# EasyEDA Pro project Athena.eprj, schematic Schematic, sheets 3 to 4 of 4

## Sheets
3 Peripherals: Page Name: Peripherals
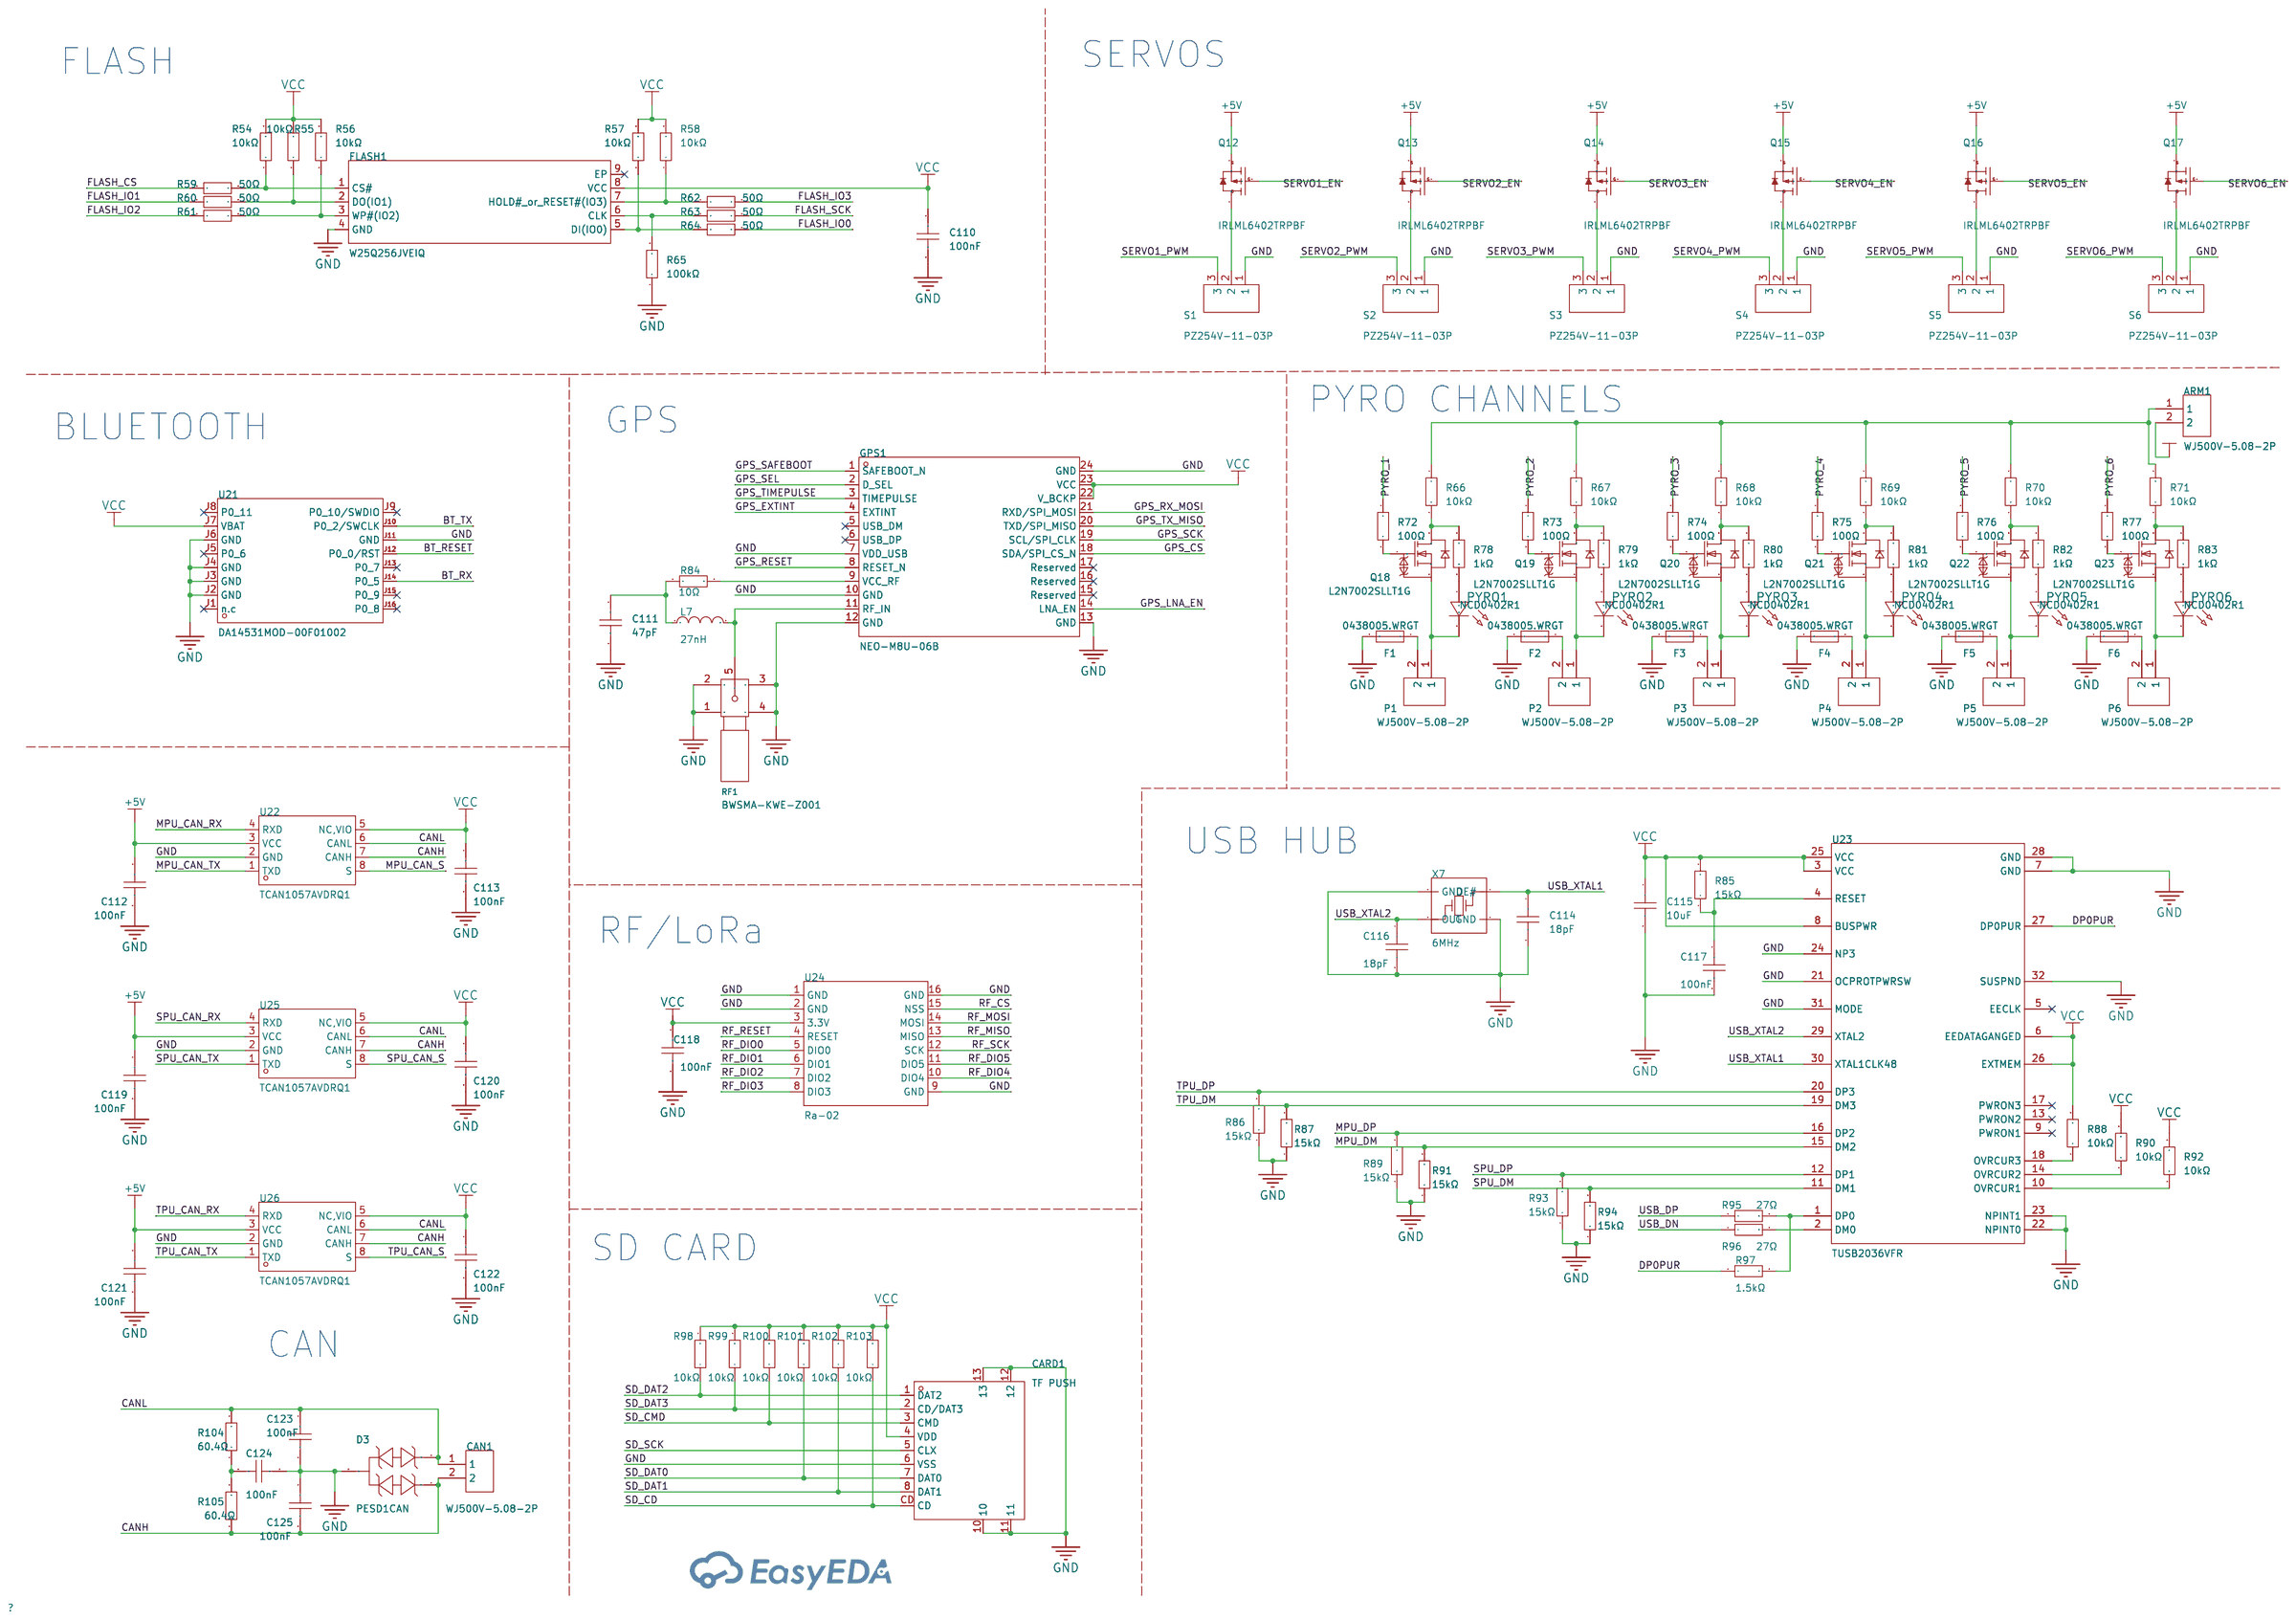
[diagram p2: Peripherals]
4 Sensors: Page Name: Sensors; Update Date: 2025-08-21
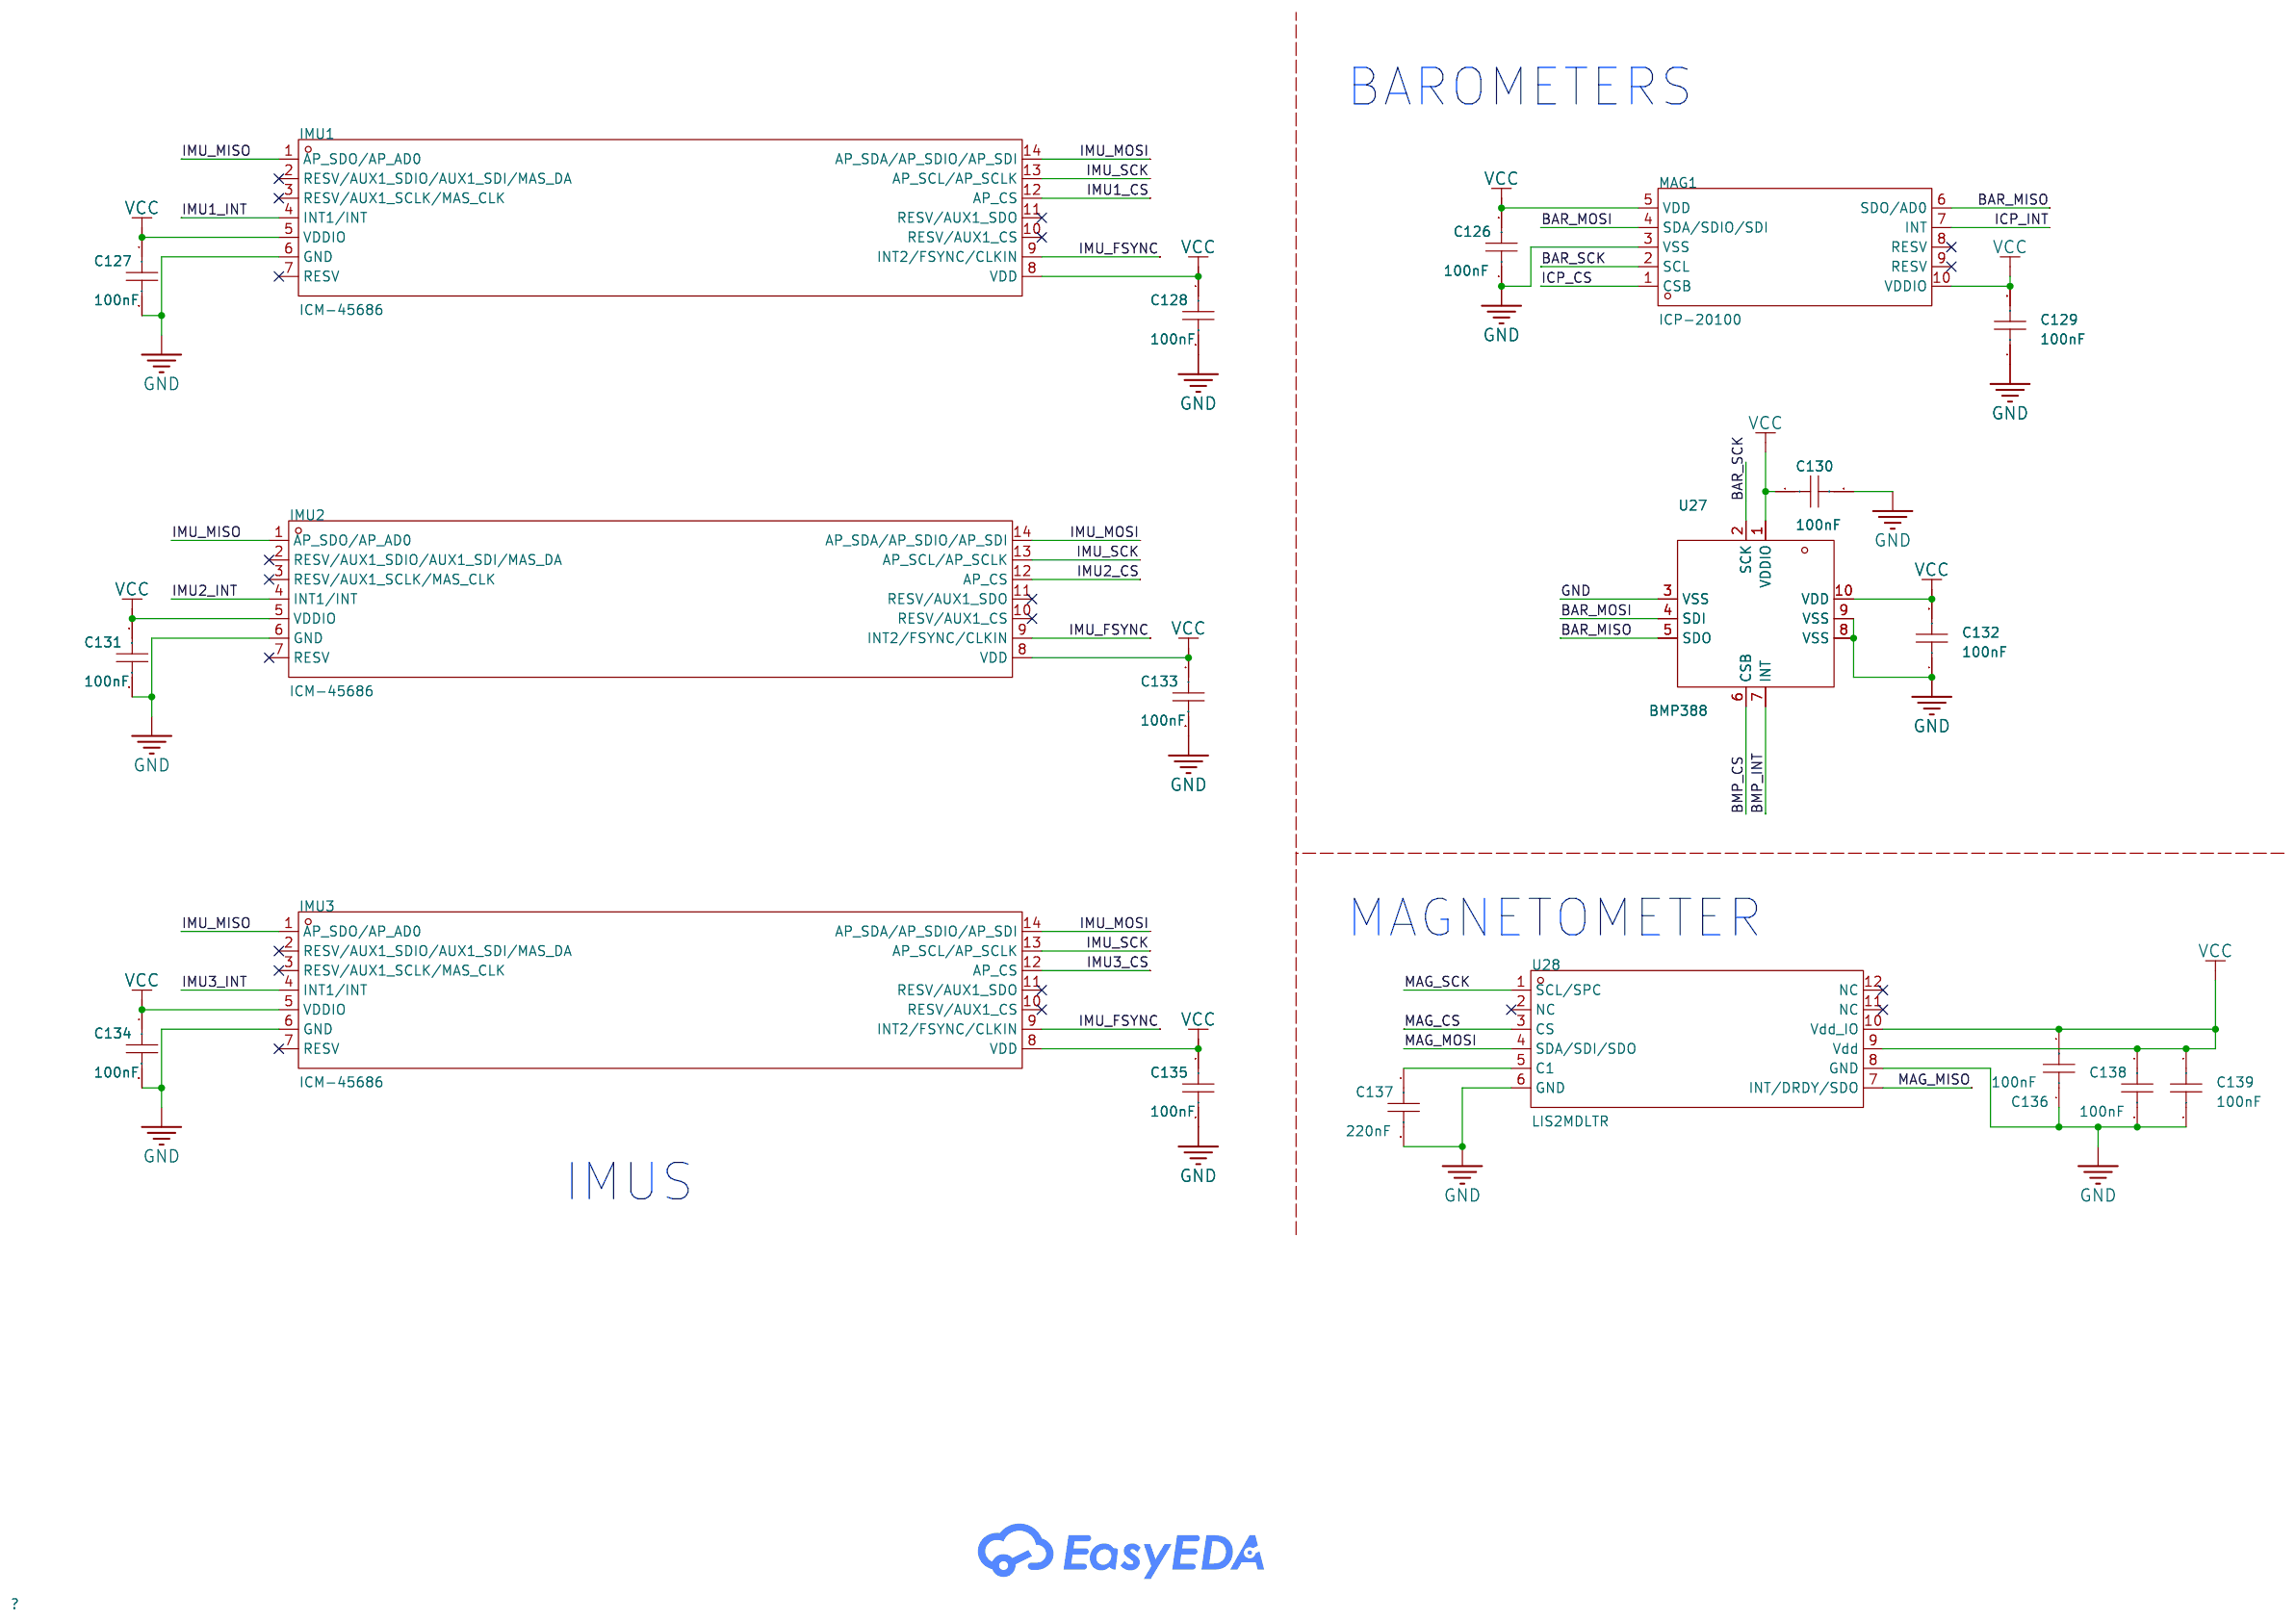
[diagram p3: Sensors]

## Parts
sheet Peripherals
ARM1  WJ500V-5.08-2P  [CONN-TH_2P-P5.00_WJ500V-5.08-2P]
C110  100nF  [C0402]
C111  47pF  [C0402]
C112  100nF  [C0402]
C113  100nF  [C0402]
C114  18pF  [C0402]
C115  10uF  [C0805]
C116  18pF  [C0402]
C117  100nF  [C0402]
C118  100nF  [C0402]
C119  100nF  [C0402]
C120  100nF  [C0402]
C121  100nF  [C0402]
C122  100nF  [C0402]
C123  100nF  [C0402]
C124  100nF  [C0402]
C125  100nF  [C0402]
CAN1  WJ500V-5.08-2P  [CONN-TH_2P-P5.00_WJ500V-5.08-2P]
CARD1  TF PUSH  [TF-SMD_TF-PUSH]
D3  PESD1CAN  [SOT-23-3_L2.9-W1.6-P1.90-LS2.8-BR]
F1  0438005.WRGT  [F0603]
F2  0438005.WRGT  [F0603]
F3  0438005.WRGT  [F0603]
F4  0438005.WRGT  [F0603]
F5  0438005.WRGT  [F0603]
F6  0438005.WRGT  [F0603]
FLASH1  W25Q256JVEIQ  [WSON-8_L8.0-W6.10-P1.27-BL-EP]
GPS1  NEO-M8U-06B  [GPSM-SMD_24P-L16.0-W12.2-P1.10-TL]
L7  27nH  [L0402-RD]
P1  WJ500V-5.08-2P  [CONN-TH_2P-P5.00_WJ500V-5.08-2P]
P2  WJ500V-5.08-2P  [CONN-TH_2P-P5.00_WJ500V-5.08-2P]
P3  WJ500V-5.08-2P  [CONN-TH_2P-P5.00_WJ500V-5.08-2P]
P4  WJ500V-5.08-2P  [CONN-TH_2P-P5.00_WJ500V-5.08-2P]
P5  WJ500V-5.08-2P  [CONN-TH_2P-P5.00_WJ500V-5.08-2P]
P6  WJ500V-5.08-2P  [CONN-TH_2P-P5.00_WJ500V-5.08-2P]
PYRO1  NCD0402R1  [LED0402-RD]
PYRO2  NCD0402R1  [LED0402-RD]
PYRO3  NCD0402R1  [LED0402-RD]
PYRO4  NCD0402R1  [LED0402-RD]
PYRO5  NCD0402R1  [LED0402-RD]
PYRO6  NCD0402R1  [LED0402-RD]
Q12  IRLML6402TRPBF  [SOT-23-3_L2.9-W1.3-P1.90-LS2.4-BR]
Q13  IRLML6402TRPBF  [SOT-23-3_L2.9-W1.3-P1.90-LS2.4-BR]
Q14  IRLML6402TRPBF  [SOT-23-3_L2.9-W1.3-P1.90-LS2.4-BR]
Q15  IRLML6402TRPBF  [SOT-23-3_L2.9-W1.3-P1.90-LS2.4-BR]
Q16  IRLML6402TRPBF  [SOT-23-3_L2.9-W1.3-P1.90-LS2.4-BR]
Q17  IRLML6402TRPBF  [SOT-23-3_L2.9-W1.3-P1.90-LS2.4-BR]
Q18  L2N7002SLLT1G  [SOT-23-3_L3.0-W1.7-P0.95-LS2.9-BR]
Q19  L2N7002SLLT1G  [SOT-23-3_L3.0-W1.7-P0.95-LS2.9-BR]
Q20  L2N7002SLLT1G  [SOT-23-3_L3.0-W1.7-P0.95-LS2.9-BR]
Q21  L2N7002SLLT1G  [SOT-23-3_L3.0-W1.7-P0.95-LS2.9-BR]
Q22  L2N7002SLLT1G  [SOT-23-3_L3.0-W1.7-P0.95-LS2.9-BR]
Q23  L2N7002SLLT1G  [SOT-23-3_L3.0-W1.7-P0.95-LS2.9-BR]
R54  10kΩ  [R0402]
R55  10kΩ  [R0402]
R56  10kΩ  [R0402]
R57  10kΩ  [R0402]
R58  10kΩ  [R0402]
R59  50Ω  [R0402]
R60  50Ω  [R0402]
R61  50Ω  [R0402]
R62  50Ω  [R0402]
R63  50Ω  [R0402]
R64  50Ω  [R0402]
R65  100kΩ  [R0402]
R66  10kΩ  [R0402]
R67  10kΩ  [R0402]
R68  10kΩ  [R0402]
R69  10kΩ  [R0402]
R70  10kΩ  [R0402]
R71  10kΩ  [R0402]
R72  100Ω  [R0402]
R73  100Ω  [R0402]
R74  100Ω  [R0402]
R75  100Ω  [R0402]
R76  100Ω  [R0402]
R77  100Ω  [R0402]
R78  1kΩ  [R0402]
R79  1kΩ  [R0402]
R80  1kΩ  [R0402]
R81  1kΩ  [R0402]
R82  1kΩ  [R0402]
R83  1kΩ  [R0402]
R84  10Ω  [R0402]
R85  15kΩ  [R0402]
R86  15kΩ  [R0402]
R87  15kΩ  [R0402]
R88  10kΩ  [R0402]
R89  15kΩ  [R0402]
R90  10kΩ  [R0402]
R91  15kΩ  [R0402]
R92  10kΩ  [R0402]
R93  15kΩ  [R0402]
R94  15kΩ  [R0402]
R95  27Ω  [R0402]
R96  27Ω  [R0402]
R97  1.5kΩ  [R0402]
R98  10kΩ  [R0402]
R99  10kΩ  [R0402]
R100  10kΩ  [R0402]
R101  10kΩ  [R0402]
R102  10kΩ  [R0402]
R103  10kΩ  [R0402]
R104  60.4Ω  [R0402]
R105  60.4Ω  [R0402]
RF1  BWSMA-KWE-Z001  [SMA-TH_BWSMA-KWE-Z001]
S1  PZ254V-11-03P  [HDR-TH_3P-P2.54-V-M]
S2  PZ254V-11-03P  [HDR-TH_3P-P2.54-V-M]
S3  PZ254V-11-03P  [HDR-TH_3P-P2.54-V-M]
S4  PZ254V-11-03P  [HDR-TH_3P-P2.54-V-M]
S5  PZ254V-11-03P  [HDR-TH_3P-P2.54-V-M]
S6  PZ254V-11-03P  [HDR-TH_3P-P2.54-V-M]
U21  DA14531MOD-00F01002  [WIRELM-SMD-16_L14.5-W12.5-P1.50-DA14531MOD]
U22  TCAN1057AVDRQ1  [SOIC-8_L4.9-W3.9-P1.27-LS6.0-BL]
U23  TUSB2036VFR  [LQFP-32_L7.0-W7.0-P0.80-LS9.0-BL]
U24  Ra-02  [WIRELM-SMD_RA-02-BL]
U25  TCAN1057AVDRQ1  [SOIC-8_L4.9-W3.9-P1.27-LS6.0-BL]
U26  TCAN1057AVDRQ1  [SOIC-8_L4.9-W3.9-P1.27-LS6.0-BL]
X7  6MHz  [OSC-SMD_4P-L7.0-W5.0-BL_ABMM]
sheet Sensors
C126  100nF  [C0402]
C127  100nF  [C0402]
C128  100nF  [C0402]
C129  100nF  [C0402]
C130  100nF  [C0402]
C131  100nF  [C0402]
C132  100nF  [C0402]
C133  100nF  [C0402]
C134  100nF  [C0402]
C135  100nF  [C0402]
C136  100nF  [C0402]
C137  220nF  [C0402]
C138  100nF  [C0402]
C139  100nF  [C0402]
IMU1  ICM-45686  [LGA-14_L3.0-W2.5-P0.50-TL]
IMU2  ICM-45686  [LGA-14_L3.0-W2.5-P0.50-TL]
IMU3  ICM-45686  [LGA-14_L3.0-W2.5-P0.50-TL]
MAG1  ICP-20100  [LGA-10_L2.0-W2.0-P0.50-TL_ICP-20100]
U27  BMP388  [SENSORM-SMD_BMP388]
U28  LIS2MDLTR  [LGA-12_L2.0-W2.0-P0.50-BL]

## Library data of the parts
ARM1 CAN1 P1-P6 = WJ500V-5.08-2P: LCSC Part Name: 1x2P 5.08mm 直插 排数:1 每排P数:2; Supplier Part: C8465; Manufacturer: KANGNEX(康奈克斯电气); Supplier Footprint: 插件,P=5.08mm; JLCPCB Part Class: Extended Part; Datasheet: https://atta.szlcsc.com/upload/public/pdf/source/20191225/C8465_02D34CE5B5B4A53DF5891601D97FA9F4.pdf; Supplier: LCSC; Structure: 1x2P; Pitch: 5.08mm; Color: Green; Mounting Style: Direct Insert; Current Rating (Max): 18A; Voltage Rating (Max): 250V; Number of Pins: 2P; Number of Rows: 1; Wire Gauge - AWG: 14~30; Wire Gauge - mm2: 2.5; Number of PINs Per Row: 2; Operating Temperature Range: -40℃~+105℃; Screw Specification: M2.5
C110 C112 C113 C117-C136 C138 C139 = GRM155R71H104KE14D: LCSC Part Name: 100nF ±10% 50V; Supplier Part: C77020; Manufacturer: muRata(村田); Supplier Footprint: 0402; JLCPCB Part Class: Extended Part; Datasheet: https://atta.szlcsc.com/upload/public/pdf/source/20180326/C77020_39BD49C951FF1AF0DB1F1FAC5AC1E401.pdf; Supplier: LCSC; Tolerance: ±10%; Standardization Check: false
C111 = GRM1555C1H470JA01D: LCSC Part Name: 47pF ±5% 50V; Supplier Part: C76970; Manufacturer: muRata(村田); Supplier Footprint: 0402; JLCPCB Part Class: Extended Part; Datasheet: https://atta.szlcsc.com/upload/public/pdf/source/20180326/C76970_6FDF160D4C40A32DF03646FA34DB0595.pdf; Supplier: LCSC; Tolerance: ±5%; Standardization Check: false
C114 C116 = CC0402JRNPO9BN180: LCSC Part Name: 18pF ±5% 50V; Supplier Part: C106202; Manufacturer: YAGEO(国巨); Supplier Footprint: 0402; JLCPCB Part Class: Extended Part; Datasheet: https://item.szlcsc.com/datasheet/CC0402JRNPO9BN180/107417.html; Supplier: LCSC; Tolerance: ±5%; Voltage Rating: 50V; Temperature Coefficient: NP0; Standardization Check: false
C115 = GRM21BR61H106KE43L: LCSC Part Name: 10uF ±10% 50V; Supplier Part: C440198; Manufacturer: muRata(村田); Supplier Footprint: 0805; JLCPCB Part Class: Basic Part; Datasheet: https://atta.szlcsc.com/upload/public/pdf/source/20230811/95AAE0C9AF55EDC31B7A4D8B733F534E.pdf; Supplier: LCSC; Tolerance: ±10%; Standardization Check: false
CARD1 = TF PUSH: Card Connection Mode:Self-bouncing Card Type:MicroSD card (TF card) Connector Type:Card Slot Additional Card Detection Pins:None Supplementary Features:- Maximum Body Height:2mm Operating Temperature Range:-20℃~+90℃ Operating Temperature Range:-20℃~+90℃; LCSC Part Name: 自弹式 MicroSD卡(TF卡) 卡座; Supplier Part: C393941; Manufacturer: SHOU HAN(首韩); Supplier Footprint: SMD; JLCPCB Part Class: Extended Part; Datasheet: https://atta.szlcsc.com/upload/public/pdf/source/20191011/C393941_0DDD896EE907FEB750D8B7B8982E2A67.pdf; Supplier: LCSC; Card Connection Mode: Self-bouncing; Card Type: MicroSD card (TF card); Connector Type: Card Slot; Additional Card Detection Pins: None; Maximum Body Height: 2mm; Operating Temperature Range: -20℃~+90℃
D3 = PESD1CAN_C907838: LCSC Part Name: PESD1CAN 丝印tAN 双向24V; Supplier Part: C907838; Manufacturer: TECH PUBLIC(台舟); Supplier Footprint: SOT-23; JLCPCB Part Class: Extended Part; Datasheet: https://atta.szlcsc.com/upload/public/pdf/source/20210810/FCC54A7A88EA9EF2EA40F9636152B7D7.pdf; Supplier: LCSC; Polarity: Bidirectional; Reverse Stand-Off Voltage (Vrwm): 24V; Clamping Voltage: 50V; Peak Pulse Current (Ipp): 3A; Peak Pulse Power Dissipation (Ppp): 150W; Voltage - Breakdown: 25V; Reverse Leakage Current (Ir): 80nA; Number of Channels: Dual channel; Operating Temperature: -55℃~+125℃; level of protection: IEC 61000-4-2; Type: ESD
F1-F6 = 0438005.WRGT: LCSC Part Name: 12V贴片式陶瓷保险丝; Supplier Part: C206961; Manufacturer: Littelfuse(美国力特); Supplier Footprint: 0603; JLCPCB Part Class: Extended Part; Datasheet: https://atta.szlcsc.com/upload/public/pdf/source/20180622/C221526_4FA6BB8CAFBB117CF66A16621571BD77.pdf; Supplier: LCSC; Type: Surface Mount Fuse; Current Rating: 5A; Voltage Rating (AC): 12V; Voltage Rating (DC): 32V; Operating Temperature: -55℃~+150℃; Interrupt Rating: 50A；50A
FLASH1 = W25Q256JVEIQ_C97522: Interface:SPI Memory Size:256Mbit Clock Frequency:133MHz Voltage - Supply:2.7V~3.6V Voltage - Supply:2.7V~3.6V Program / Erase Cycles:100,000 Cycles Page Programming Time (Tpp):700us Block Erase Time(tBE):120ms@(32KB) Data Retention - TDR (Year):20 Years; Supplier Part: C97522; Manufacturer: Winbond(华邦); Supplier Footprint: WSON-8-EP(6x8); JLCPCB Part Class: Extended Part; Datasheet: https://atta.szlcsc.com/upload/public/pdf/source/20190529/C97522_47AE152D0BB11FB4C8509E398C0AD2EA.pdf; Supplier: LCSC; Interface: SPI; Memory Size: 256Mbit; Clock Frequency: 133MHz; Voltage - Supply: 2.7V~3.6V; Program / Erase Cycles: 100,000 Cycles; Page Programming Time (Tpp): 700us; Block Erase Time(tBE): 120ms@(32KB); Data Retention - TDR (Year): 20 Years; Operating Temperature: -40℃~+85℃
GPS1 = NEO-M8U-06B: GNSS Type:Galileo；GLONASS；GPS；BeiDou Interface:UART；I2C；USB；SPI Voltage - Supply:2.7V~3.6V Voltage - Supply:2.7V~3.6V Sensitivity:-160dBm Sensitivity:-160dBm Operating Temperature:-40℃~+85℃ Operating Temperature:-40℃~+85℃; Supplier Part: C7009321; Manufacturer: U-BLOX; Supplier Footprint: SMD-24P; JLCPCB Part Class: Extended Part; Datasheet: https://atta.szlcsc.com/upload/public/pdf/source/20240423/523A52209E2FEFC8D2EB30DE7E259982.pdf; Supplier: LCSC; GNSS Type: Galileo；GLONASS；GPS；BeiDou; Interface: UART；I2C；USB；SPI; Voltage - Supply: 2.7V~3.6V; Sensitivity: -160dBm; Operating Temperature: -40℃~+85℃
L7 = LQG15HS27NJ02D: Inductance:27nH Tolerance:±5% Tolerance:±5% Current Rating:350mA Current - Saturation (Isat):- DC Resistance(DCR):460mΩ Q @ Frequency:8@100MHz Frequency - Self Resonant:1.7GHz Ratings:-; LCSC Part Name: 27nH ±5%; Supplier Part: C12669; Manufacturer: muRata(村田); Supplier Footprint: 0402; JLCPCB Part Class: Extended Part; Datasheet: https://atta.szlcsc.com/upload/public/pdf/source/20170810/C86059_1502335402466879997.pdf; Supplier: LCSC; Tolerance: ±5%; Current Rating: 350mA; DC Resistance(DCR): 460mΩ; Q @ Frequency: 8@100MHz; Frequency - Self Resonant: 1.7GHz
PYRO1-PYRO6 = NCD0402R1: LCSC Part Name: 片式发光二极管; Supplier Part: C130719; Manufacturer: 国星光电; Supplier Footprint: 0402; JLCPCB Part Class: Extended Part; Datasheet: https://item.szlcsc.com/datasheet/NCD0402R1/142008.html; Supplier: LCSC; Illumination Color: Red; Voltage - Forward(Vf): 1.6V~2.6V; Power(Watts): 65mW; Forward Current: 25mA; Wavelength - Dominant: 615nm~635nm; Peak Wavelength: 630nm; Luminous Intensity: 30mcd; Viewing Angle: 130°; Operating Temperature: -30℃~+85℃
Q12-Q17 = IRLML6402TRPBF_C5182043: LCSC Part Name: 耐压:20V 电流:4.1A; Supplier Part: C5182043; Manufacturer: TECH PUBLIC(台舟); Supplier Footprint: SOT-23; JLCPCB Part Class: Extended Part; Datasheet: https://atta.szlcsc.com/upload/public/pdf/source/20220927/12236270C43F3DBD5C0C580A83B7F035.pdf; Supplier: LCSC; Drain to Source Voltage: 20V; RDS(on): 75mΩ@2.5V,4.1A; Pd - Power Dissipation: 1.7W; Gate Threshold Voltage (Vgs(th)@Id): 1V; Gate Charge(Qg): 7.8nC@4.5V; Input Capacitance(Ciss@Vds): 740pF@4V; Reverse Transfer Capacitance (Crss@Vds): 190pF@4V; Operating Temperature: -55℃~+150℃
Q18-Q23 = L2N7002SLLT1G: LCSC Part Name: 1个N沟道 耐压:60V 电流:380mA; Supplier Part: C22446827; Manufacturer: LRC(乐山无线电); Supplier Footprint: SOT-23; JLCPCB Part Class: Extended Part; Datasheet: https://atta.szlcsc.com/upload/public/pdf/source/20240529/804683F6F610BC810C43B61F364F3FCA.pdf; Supplier: LCSC; Type: 1 N-channel; Drain to Source Voltage: 60V; RDS(on): 2.8Ω@10V,500mA; Pd - Power Dissipation: 300mW; Gate Charge(Qg): 440pC@4.5V; Input Capacitance(Ciss@Vds): 35pF@25V; Operating Temperature: -55℃~+150℃
R54-R58 R66-R71 R88 R90 R92 R98-R103 = 0402WGF1002TCE: LCSC Part Name: 10kΩ ±1% 62.5mW 厚膜电阻; Supplier Part: C25744; Manufacturer: UNI-ROYAL(厚声); Supplier Footprint: 0402; JLCPCB Part Class: Basic Part; Datasheet: https://item.szlcsc.com/datasheet/0402WGF1002TCE/26487.html; Supplier: LCSC; Type: Thick Film Resistor; Tolerance: ±1%; Power(Watts): 62.5mW; Voltage-Supply(Max): 50V; Temperature Coefficient: ±100ppm/℃; Operating Temperature: -55℃~+155℃; Standardization Check: false
R59-R64 = RT0402BRE0750RL: LCSC Part Name: 薄膜电阻 50Ω ±0.1% 62.5mW; Supplier Part: C853312; Manufacturer: YAGEO(国巨); Supplier Footprint: 0402; JLCPCB Part Class: Extended Part; Datasheet: https://atta.szlcsc.com/upload/public/pdf/source/20200610/C326738_5639A9F1B6EB6E4AE2197577D3456E7F.pdf; Supplier: LCSC; Type: Thin Film Resistor; Tolerance: ±0.1%; Temperature Coefficient: ±50ppm/℃; Operating Temperature Range: -55℃~+155℃; Standardization Check: false
R65 = 0402WGF1003TCE: LCSC Part Name: 100kΩ ±1% 62.5mW 厚膜电阻; Supplier Part: C25741; Manufacturer: UNI-ROYAL(厚声); Supplier Footprint: 0402; JLCPCB Part Class: Basic Part; Datasheet: https://item.szlcsc.com/datasheet/0402WGF1003TCE/26484.html; Supplier: LCSC; Type: Thick Film Resistor; Tolerance: ±1%; Power(Watts): 62.5mW; Voltage-Supply(Max): 50V; Temperature Coefficient: ±100ppm/℃; Operating Temperature: -55℃~+155℃; Standardization Check: false
R72-R77 = 0402WGF1000TCE: LCSC Part Name: 100Ω ±1% 62.5mW 厚膜电阻; Supplier Part: C25076; Manufacturer: UNI-ROYAL(厚声); Supplier Footprint: 0402; JLCPCB Part Class: Basic Part; Datasheet: https://atta.szlcsc.com/upload/public/pdf/source/20200306/C422600_1E6D84923E4A46A82E41ADD87F860B5C.pdf; Supplier: LCSC; Type: Thick Film Resistors; Tolerance: ±1%; Temperature Coefficient: ±200ppm/℃; Operating Temperature Range: -55℃~+155℃; Standardization Check: false
R78-R83 = 0402WGF1001TCE: LCSC Part Name: 1kΩ ±1% 62.5mW 厚膜电阻; Supplier Part: C11702; Manufacturer: UNI-ROYAL(厚声); Supplier Footprint: 0402; JLCPCB Part Class: Basic Part; Datasheet: https://item.szlcsc.com/datasheet/0402WGF1001TCE/12256.html; Supplier: LCSC; Type: Thick Film Resistor; Tolerance: ±1%; Power(Watts): 62.5mW; Voltage-Supply(Max): 50V; Temperature Coefficient: ±100ppm/℃; Operating Temperature: -55℃~+155℃; Standardization Check: false
R84 = 0402WGF100JTCE: LCSC Part Name: 10Ω ±1% 62.5mW 厚膜电阻; Supplier Part: C25077; Manufacturer: UNI-ROYAL(厚声); Supplier Footprint: 0402; JLCPCB Part Class: Basic Part; Datasheet: https://atta.szlcsc.com/upload/public/pdf/source/20200306/C422600_1E6D84923E4A46A82E41ADD87F860B5C.pdf; Supplier: LCSC; Type: Thick Film Resistors; Tolerance: ±1%; Temperature Coefficient: ±200ppm/℃; Operating Temperature Range: -55℃~+155℃; Standardization Check: false
R85-R87 R89 R91 R93 R94 = 0402WGF1502TCE: LCSC Part Name: 15kΩ ±1% 62.5mW 厚膜电阻; Supplier Part: C25756; Manufacturer: UNI-ROYAL(厚声); Supplier Footprint: 0402; JLCPCB Part Class: Basic Part; Datasheet: https://atta.szlcsc.com/upload/public/pdf/source/20200306/C422600_1E6D84923E4A46A82E41ADD87F860B5C.pdf; Supplier: LCSC; Type: Thick Film Resistors; Tolerance: ±1%; Temperature Coefficient: ±100ppm/℃; Operating Temperature Range: -55℃~+155℃; Standardization Check: false
R95 R96 = RC0402FR-0727RL: LCSC Part Name: 厚膜电阻 27Ω ±1% 62.5mW; Supplier Part: C138021; Manufacturer: YAGEO(国巨); Supplier Footprint: 0402; JLCPCB Part Class: Extended Part; Datasheet: https://item.szlcsc.com/datasheet/RC0402FR-0727RL/149337.html; Supplier: LCSC; Type: Thick Film Resistor; Tolerance: ±1%; Power(Watts): 62.5mW; Voltage-Supply(Max): 50V; Temperature Coefficient: ±100ppm/℃; Operating Temperature: -55℃~+155℃; Standardization Check: false
R97 = 0402WGF1501TCE: LCSC Part Name: 1.5kΩ ±1% 62.5mW 厚膜电阻; Supplier Part: C25867; Manufacturer: UNI-ROYAL(厚声); Supplier Footprint: 0402; JLCPCB Part Class: Basic Part; Datasheet: https://atta.szlcsc.com/upload/public/pdf/source/20200306/C422600_1E6D84923E4A46A82E41ADD87F860B5C.pdf; Supplier: LCSC; Type: Thick Film Resistors; Tolerance: ±1%; Temperature Coefficient: ±100ppm/℃; Operating Temperature Range: -55℃~+155℃; Standardization Check: false
R104 R105 = 0402WGF604JTCE: LCSC Part Name: 60.4Ω ±1% 62.5mW 厚膜电阻; Supplier Part: C60310; Manufacturer: UNI-ROYAL(厚声); Supplier Footprint: 0402; JLCPCB Part Class: Extended Part; Datasheet: https://item.szlcsc.com/datasheet/0402WGF604JTCE/61362.html; Supplier: LCSC; Type: Thick Film Resistor; Tolerance: ±1%; Power(Watts): 62.5mW; Voltage-Supply(Max): 50V; Temperature Coefficient: ±100ppm/℃; Operating Temperature: -55℃~+155℃; Standardization Check: false
RF1 = BWSMA-KWE-Z001: LCSC Part Name: 内孔 SMA 弯头; Supplier Part: C496551; Manufacturer: BAT WIRELESS(蝙蝠无线); Supplier Footprint: 插件; JLCPCB Part Class: Extended Part; Datasheet: https://atta.szlcsc.com/upload/public/pdf/source/20231017/997A8C2ADA7F8034A89BE1264F38CE52.pdf; Supplier: LCSC; Connector Type: 板端; Interface Type: 内孔; Number of Ports: 1; Interface Diameter: 5.3mm; RF Series: SMA; Impedance: 50Ω; Style: 弯头
S1-S6 = PZ254V-11-03P: LCSC Part Name: 1x3P 间距:2.54mm 方针 直插; Supplier Part: C2937625; Manufacturer: XFCN(兴飞); Supplier Footprint: 插件,P=2.54mm; JLCPCB Part Class: Extended Part; Datasheet: https://atta.szlcsc.com/upload/public/pdf/source/20200309/C492402_8335C3D49C4E4C618838D59BB1D024C1.pdf; Supplier: LCSC; Pin Structure: 1x3P; Pitch: 2.54mm; Circluar Pins/Square Pins: Policy; Mounting Type: Straight; Number of Rows: Single Row; Number of Pins: 3P; Current Rating: 3A; Voltage Rating (Max): 250V; Length of Mating Pin: 6mm; Insulation Height: 2.5mm; Length of End Connection Pin: 3mm; Operating Temperature: -40℃~+105℃; Color: Black
U21 = DA14531MOD-00F01002_C5360767: Supplier Part: C5360767; Manufacturer: RENESAS(瑞萨)/IDT; Supplier Footprint: LCC-16(14.5X12.5); JLCPCB Part Class: Extended Part; Datasheet: https://atta.szlcsc.com/upload/public/pdf/source/20230904/782F293C6A7A9CB0F12D980FA94C2DB0.pdf; Supplier: LCSC
U22 U25 U26 = TCAN1057AVDRQ1: LCSC Part Name: 具有故障保护功能的TCAN1057A-Q1和TCAN1057AV-Q1汽车类CANFD收发器; Supplier Part: C3235000; Manufacturer: TI(德州仪器); Supplier Footprint: SOIC-8; JLCPCB Part Class: Extended Part; Datasheet: https://www.ti.com/cn/lit/gpn/tcan1057a-q1; Supplier: LCSC; Type: CAN FD Transceiver; Data Rate: 8Mbps; Voltage - Supply: 4.5V~5.5V; Operating Temperature: -40℃~+150℃
U23 = TUSB2036VFR: type:Hub Protocol:USB 2.0 Data Rate:12Mbps Supply Voltage:3.3V Supply Voltage:3.3V Operating Temperature:0℃~+70℃ Operating Temperature:0℃~+70℃; LCSC Part Name: TUSB2036 2/3-端口USB集线器; Supplier Part: C43665; Manufacturer: TI(德州仪器); Supplier Footprint: LQFP-32(7x7); JLCPCB Part Class: Extended Part; Datasheet: https://www.ti.com/cn/lit/gpn/tusb2036; Supplier: LCSC; type: Hub; Protocol: USB 2.0; Data Rate: 12Mbps; Supply Voltage: 3.3V; Operating Temperature: 0℃~+70℃
U24 = Ra-02_C90039: LCSC Part Name: 433MHz LORA扩频无线模块 超远10KM SX1278; Supplier Part: C90039; Manufacturer: Ai-Thinker(安信可); Supplier Footprint: SMD-16P; JLCPCB Part Class: Extended Part; Datasheet: https://item.szlcsc.com/datasheet/Ra-02/91224.html; Supplier: LCSC; Output Power: 18dBm; Interface Type: SPI; Modulation System: LoRa；OOK；MSK；GFSK；FSK；GMSK; Voltage - Supply: 2.5V~3.7V; Antenna Type: IPEX Connector; Receive  Current: 12.15mA; Send  Current: 93mA；97mA; Sensitivity: -141dBm; Operating Temperature: -40℃~+85℃
X7 = ABMM-6.000MHZ-B2-T: LCSC Part Name: 6MHz ±20ppm 18pF; Supplier Part: C179631; Manufacturer: ABRACON; Supplier Footprint: SMD7050-4P; JLCPCB Part Class: Extended Part; Datasheet: https://atta.szlcsc.com/upload/public/pdf/source/20180207/C179631_15179896470941356360.pdf; Supplier: LCSC; Normal temperature Frequency Tolerance: ±20ppm; Frequency Stability(Full temperature range): ±50ppm; Equivalent Series Resistance (ESR): 70Ω
C137 = GRM155R61H224KE01D: LCSC Part Name: 220nF ±10% 50V; Supplier Part: C5159775; Manufacturer: muRata(村田); Supplier Footprint: 0402; JLCPCB Part Class: Extended Part; Datasheet: https://atta.szlcsc.com/upload/public/pdf/source/20220908/127FBF727F40FD963FE6EF3339C3E648.pdf; Supplier: LCSC; Tolerance: ±10%; Standardization Check: false
IMU1-IMU3 = ICM-45686: Supplier Part: C22459454; Manufacturer: TDK InvenSense(应美盛); Supplier Footprint: LGA-14(3x2.5); JLCPCB Part Class: Extended Part; Datasheet: https://item.szlcsc.com/datasheet/ICM-45686/24135842.html; Supplier: LCSC
MAG1 = ICP-20100: Supplier Part: C5343527; Manufacturer: TDK InvenSense(应美盛); Supplier Footprint: LGA-10L; JLCPCB Part Class: Extended Part; Datasheet: https://atta.szlcsc.com/upload/public/pdf/source/20240425/CCFF2FA4E81D8291B70FD66D3D391C92.pdf; Supplier: LCSC
U27 = BMP388: Pressure range:30Kpa~125Kpa Pressure range:30Kpa~125Kpa Voltage - Supply:1.65V~3.6V Voltage - Supply:1.65V~3.6V Operating Temperature:- Operating Temperature:-; Supplier Part: C779278; Manufacturer: Bosch(博世); Supplier Footprint: LGA-10(2x2); JLCPCB Part Class: Extended Part; Datasheet: https://atta.szlcsc.com/upload/public/pdf/source/20211019/91C230A1D32F1E776DA878FFB43C8B15.pdf; Supplier: LCSC; Pressure range: 30Kpa~125Kpa; Voltage - Supply: 1.65V~3.6V
U28 = LIS2MDLTR: LCSC Part Name: 霍尔效应开关; Supplier Part: C919695; Manufacturer: ST(意法半导体); Supplier Footprint: LGA-12(2x2); JLCPCB Part Class: Extended Part; Datasheet: https://atta.szlcsc.com/upload/public/pdf/source/20211119/145E3A73C2A09E2C981D93C27CF540FA.pdf; Supplier: LCSC

## Nets
+5V: C112.1 C119.1 C121.1 Q12.2(S) Q13.2(S) Q14.2(S) Q15.2(S) Q16.2(S) Q17.2(S) U22.3(VCC) U25.3(VCC) U26.3(VCC) ; also on sheet 1 2
GND: C110.2 C111.2 C112.2 C113.2 C114.2 C115.2 C116.2 C117.2 C118.2 C119.2 C120.2 C121.2 C122.2 C123.2 C124.2 C125.1 C126.1 C127.2 C128.2 C129.1 C130.2 C131.2 C132.1 C133.2 C134.2 C135.2 C136.1 C137.2 C138.2 C139.2 CARD1.6(VSS) CARD1.10 CARD1.11 CARD1.12 CARD1.13 D3.3 F1.2 F2.2 F3.2 F4.2 F5.2 F6.2 FLASH1.4(GND) GPS1.7(VDD_USB) GPS1.10(GND) GPS1.12(GND) GPS1.13(GND) GPS1.24(GND) IMU1.6(GND) IMU2.6(GND) IMU3.6(GND) MAG1.3(VSS) R65.1 R86.1 R87.1 R89.1 R91.1 R93.1 R94.1 RF1.1 RF1.2 RF1.3 RF1.4 S1.1 S2.1 S3.1 S4.1 S5.1 S6.1 U21.J2(GND) U21.J3(GND) U21.J4(GND) U21.J6(GND) U21.J11(GND) U22.2(GND) U23.7(GND) U23.21(OCPROTPWRSW) U23.22(NPINT0) U23.23(NPINT1) U23.24(NP3) U23.28(GND) U23.31(MODE) U23.32(SUSPND) U24.1(GND) U24.2(GND) U24.9(GND) U24.16(GND) U25.2(GND) U26.2(GND) U27.3(VSS) U27.8(VSS) U27.9(VSS) U28.6(GND) U28.8(GND) X7.2(GND) X7.4(GND) ; also on sheet 1 2
VCC: C110.1 C113.1 C115.1 C118.1 C120.1 C122.1 C126.2 C127.1 C128.1 C129.2 C130.1 C131.1 C132.2 C133.1 C134.1 C135.1 C136.2 C138.1 C139.1 CARD1.4(VDD) FLASH1.8(VCC) GPS1.22(V_BCKP) GPS1.23(VCC) IMU1.5(VDDIO) IMU1.8(VDD) IMU2.5(VDDIO) IMU2.8(VDD) IMU3.5(VDDIO) IMU3.8(VDD) MAG1.5(VDD) MAG1.10(VDDIO) R54.2 R55.2 R56.2 R57.2 R58.2 R85.2 R88.2 R90.2 R92.2 R98.2 R99.2 R100.2 R101.2 R102.2 R103.2 U21.J7(VBAT) U22.5(NC,VIO) U23.3(VCC) U23.6(EEDATAGANGED) U23.8(BUSPWR) U23.25(VCC) U23.26(EXTMEM) U24.3(3.3V) U25.5(NC,VIO) U26.5(NC,VIO) U27.1(VDDIO) U27.10(VDD) U28.9(Vdd) U28.10(Vdd_IO) ; also on sheet 1 2
BAR_MISO: MAG1.6(SDO/AD0) U27.5(SDO) ; also on sheet 1
BAR_MOSI: MAG1.4(SDA/SDIO/SDI) U27.4(SDI) ; also on sheet 1
BAR_SCK: MAG1.2(SCL) U27.2(SCK) ; also on sheet 1
BAT: ARM1.2 ; also on sheet 2
BMP_CS: U27.6(CSB) ; also on sheet 1
BMP_INT: U27.7(INT) ; also on sheet 1
BT_RESET: U21.J12(P0_0/RST) ; also on sheet 1
BT_RX: U21.J14(P0_5) ; also on sheet 1
BT_TX: U21.J10(P0_2/SWCLK) ; also on sheet 1
CANH: C125.2 CAN1.2 D3.1 R105.1 U22.7(CANH) U25.7(CANH) U26.7(CANH)
CANL: C123.1 CAN1.1 D3.2 R104.2 U22.6(CANL) U25.6(CANL) U26.6(CANL)
DP0PUR: R97.1 U23.27(DP0PUR)
FLASH_CS: R59.1 ; also on sheet 1
FLASH_IO0: R64.2 ; also on sheet 1
FLASH_IO1: R60.1 ; also on sheet 1
FLASH_IO2: R61.1 ; also on sheet 1
FLASH_IO3: R62.2 ; also on sheet 1
FLASH_SCK: R63.2 ; also on sheet 1
GPS_CS: GPS1.18(SDA/SPI CS_N) ; also on sheet 1
GPS_EXTINT: GPS1.4(EXTINT) ; also on sheet 1
GPS_LNA_EN: GPS1.14(LNA_EN) ; also on sheet 1
GPS_RESET: GPS1.8(RESET_N) ; also on sheet 1
GPS_RX_MOSI: GPS1.21(RXD/SPI MOSI) ; also on sheet 1
GPS_SAFEBOOT: GPS1.1(SAFEBOOT_N) ; also on sheet 1
GPS_SCK: GPS1.19(SCL/SPI CLK) ; also on sheet 1
GPS_SEL: GPS1.2(D_SEL) ; also on sheet 1
GPS_TIMEPULSE: GPS1.3(TIMEPULSE) ; also on sheet 1
GPS_TX_MISO: GPS1.20(TXD/SPI MISO) ; also on sheet 1
ICP_CS: MAG1.1(CSB) ; also on sheet 1
ICP_INT: MAG1.7(INT) ; also on sheet 1
IMU1_CS: IMU1.12(AP_CS) ; also on sheet 1
IMU1_INT: IMU1.4(INT1/INT) ; also on sheet 1
IMU2_CS: IMU2.12(AP_CS) ; also on sheet 1
IMU2_INT: IMU2.4(INT1/INT) ; also on sheet 1
IMU3_CS: IMU3.12(AP_CS) ; also on sheet 1
IMU3_INT: IMU3.4(INT1/INT) ; also on sheet 1
IMU_FSYNC: IMU1.9(INT2/FSYNC/CLKIN) IMU2.9(INT2/FSYNC/CLKIN) IMU3.9(INT2/FSYNC/CLKIN) ; also on sheet 1
IMU_MISO: IMU1.1(AP_SDO/AP_AD0) IMU2.1(AP_SDO/AP_AD0) IMU3.1(AP_SDO/AP_AD0) ; also on sheet 1
IMU_MOSI: IMU1.14(AP_SDA/AP_SDIO/AP_SDI) IMU2.14(AP_SDA/AP_SDIO/AP_SDI) IMU3.14(AP_SDA/AP_SDIO/AP_SDI) ; also on sheet 1
IMU_SCK: IMU1.13(AP_SCL/AP_SCLK) IMU2.13(AP_SCL/AP_SCLK) IMU3.13(AP_SCL/AP_SCLK) ; also on sheet 1
MAG_CS: U28.3(CS) ; also on sheet 1
MAG_MISO: U28.7(INT/DRDY/SDO) ; also on sheet 1
MAG_MOSI: U28.4(SDA/SDI/SDO) ; also on sheet 1
MAG_SCK: U28.1(SCL/SPC) ; also on sheet 1
MPU_CAN_RX: U22.4(RXD) ; also on sheet 1
MPU_CAN_S: U22.8(S) ; also on sheet 1
MPU_CAN_TX: U22.1(TXD) ; also on sheet 1
MPU_DM: R91.2 U23.15(DM2) ; also on sheet 1
MPU_DP: R89.2 U23.16(DP2) ; also on sheet 1
PYRO_1: R72.1 ; also on sheet 1
PYRO_2: R73.1 ; also on sheet 1
PYRO_3: R74.1 ; also on sheet 1
PYRO_4: R75.1 ; also on sheet 1
PYRO_5: R76.1 ; also on sheet 1
PYRO_6: R77.1 ; also on sheet 1
RF_CS: U24.15(NSS) ; also on sheet 1
RF_DIO0: U24.5(DIO0) ; also on sheet 1
RF_DIO1: U24.6(DIO1) ; also on sheet 1
RF_DIO2: U24.7(DIO2) ; also on sheet 1
RF_DIO3: U24.8(DIO3) ; also on sheet 1
RF_DIO4: U24.10(DIO4) ; also on sheet 1
RF_DIO5: U24.11(DIO5) ; also on sheet 1
RF_MISO: U24.13(MISO) ; also on sheet 1
RF_MOSI: U24.14(MOSI) ; also on sheet 1
RF_RESET: U24.4(RESET) ; also on sheet 1
RF_SCK: U24.12(SCK) ; also on sheet 1
SD_CD: CARD1.CD R103.1 ; also on sheet 1
SD_CMD: CARD1.3(CMD) R100.1 ; also on sheet 1
SD_DAT0: CARD1.7(DAT0) R101.1 ; also on sheet 1
SD_DAT1: CARD1.8(DAT1) R102.1 ; also on sheet 1
SD_DAT2: CARD1.1(DAT2) R98.1 ; also on sheet 1
SD_DAT3: CARD1.2(CD/DAT3) R99.1 ; also on sheet 1
SD_SCK: CARD1.5(CLX) ; also on sheet 1
SERVO1_EN: Q12.1(G) ; also on sheet 1
SERVO1_PWM: S1.3 ; also on sheet 1
SERVO2_EN: Q13.1(G) ; also on sheet 1
SERVO2_PWM: S2.3 ; also on sheet 1
SERVO3_EN: Q14.1(G) ; also on sheet 1
SERVO3_PWM: S3.3 ; also on sheet 1
SERVO4_EN: Q15.1(G) ; also on sheet 1
SERVO4_PWM: S4.3 ; also on sheet 1
SERVO5_EN: Q16.1(G) ; also on sheet 1
SERVO5_PWM: S5.3 ; also on sheet 1
SERVO6_EN: Q17.1(G) ; also on sheet 1
SERVO6_PWM: S6.3 ; also on sheet 1
SPU_CAN_RX: U25.4(RXD) ; also on sheet 1
SPU_CAN_S: U25.8(S) ; also on sheet 1
SPU_CAN_TX: U25.1(TXD) ; also on sheet 1
SPU_DM: R94.2 U23.11(DM1) ; also on sheet 1
SPU_DP: R93.2 U23.12(DP1) ; also on sheet 1
TPU_CAN_RX: U26.4(RXD) ; also on sheet 1
TPU_CAN_S: U26.8(S) ; also on sheet 1
TPU_CAN_TX: U26.1(TXD) ; also on sheet 1
TPU_DM: R87.2 U23.19(DM3) ; also on sheet 1
TPU_DP: R86.2 U23.20(DP3) ; also on sheet 1
USB_DN: R96.1 ; also on sheet 2
USB_DP: R95.1 ; also on sheet 2
USB_XTAL1: C114.1 U23.30(XTAL1CLK48) X7.1(OE#)
USB_XTAL2: C116.1 U23.29(XTAL2) X7.3(OUT)
$3N1990: R88.1 U23.18(OVRCUR3)
$3N1994: R90.1 U23.14(OVRCUR2)
$3N1999: R92.1 U23.10(OVRCUR1)
$3N2944: R95.2 R97.2 U23.1(DP0)
$3N2998: R96.2 U23.2(DM0)
$3N4455: FLASH1.7(HOLD# or RESET#(IO3)) R58.1 R62.1
$3N4459: FLASH1.6(CLK) R63.1 R65.2
$3N4464: FLASH1.5(DI(IO0)) R57.1 R64.1
$3N4469: FLASH1.1(CS#) R54.1 R59.2
$3N4474: FLASH1.2(DO(IO1)) R55.1 R60.2
$3N4479: FLASH1.3(WP#(IO2)) R56.1 R61.2
$3N4818: C117.1 R85.1 U23.4(RESET)
$3N9159: GPS1.9(VCC_RF) R84.2
$3N9241: GPS1.11(RF_IN) L7.2 RF1.5
$3N9247: C111.1 L7.1 R84.1
$3N11683: PYRO1.1(A) R78.2
$3N11891: Q18.3(D) R66.2 R78.1
$3N11949: P1.1 PYRO1.2(C) Q18.2(S)
$3N11962: F1.1 P1.2
$3N11980: Q18.1(G) R72.2
$3N11988: ARM1.1 R66.1 R67.1 R68.1 R69.1 R70.1 R71.1
$3N12222: PYRO2.1(A) R79.2
$3N12224: Q19.3(D) R67.2 R79.1
$3N12227: P2.1 PYRO2.2(C) Q19.2(S)
$3N12231: F2.1 P2.2
$3N12235: Q19.1(G) R73.2
$3N12474: PYRO3.1(A) R80.2
$3N12476: Q20.3(D) R68.2 R80.1
$3N12479: P3.1 PYRO3.2(C) Q20.2(S)
$3N12483: F3.1 P3.2
$3N12487: Q20.1(G) R74.2
$3N13186: PYRO4.1(A) R81.2
$3N13188: Q21.3(D) R69.2 R81.1
$3N13191: P4.1 PYRO4.2(C) Q21.2(S)
$3N13195: F4.1 P4.2
$3N13199: Q21.1(G) R75.2
$3N13207: PYRO5.1(A) R82.2
$3N13209: Q22.3(D) R70.2 R82.1
$3N13212: P5.1 PYRO5.2(C) Q22.2(S)
$3N13216: F5.1 P5.2
$3N13220: Q22.1(G) R76.2
$3N13228: PYRO6.1(A) R83.2
$3N13230: Q23.3(D) R71.2 R83.1
$3N13233: P6.1 PYRO6.2(C) Q23.2(S)
$3N13237: F6.1 P6.2
$3N13241: Q23.1(G) R77.2
$3N23254: C124.1 R104.1 R105.2
$3N39600: Q12.3(D) S1.2
$3N39720: Q13.3(D) S2.2
$3N39836: Q14.3(D) S3.2
$3N39952: Q15.3(D) S4.2
$3N40068: Q16.3(D) S5.2
$3N40184: Q17.3(D) S6.2
$4N1461: C137.1 U28.5(C1)

Not connected (* = marked no-connect by the designer): FLASH1 9(EP)*; GPS1 5(USB_DM)* 6(USB_DP)* 15(Reserved)* 16(Reserved)* 17(Reserved)*; IMU1 2(RESV/AUX1_SDIO/AUX1_SDI/MAS_DA)* 3(RESV/AUX1_SCLK/MAS_CLK)* 7(RESV)* 10(RESV/AUX1_CS)* 11(RESV/AUX1_SDO)*; IMU2 2(RESV/AUX1_SDIO/AUX1_SDI/MAS_DA)* 3(RESV/AUX1_SCLK/MAS_CLK)* 7(RESV)* 10(RESV/AUX1_CS)* 11(RESV/AUX1_SDO)*; IMU3 2(RESV/AUX1_SDIO/AUX1_SDI/MAS_DA)* 3(RESV/AUX1_SCLK/MAS_CLK)* 7(RESV)* 10(RESV/AUX1_CS)* 11(RESV/AUX1_SDO)*; MAG1 8(RESV)* 9(RESV)*; U21 J1(n.c)* J5(P0_6)* J8(P0_11)* J9(P0_10/SWDIO)* J13(P0_7)* J15(P0_9)* J16(P0_8)*; U23 5(EECLK)* 9(PWRON1)* 13(PWRON2)* 17(PWRON3)*; U28 2(NC)* 11(NC)* 12(NC)*

## Notes on the sheets
sheet 3
- FLASH
- SERVOS
- PYRO CHANNELS
- GPS
- BLUETOOTH
- USB HUB
- RF/LoRa
- SD CARD
- CAN
sheet 4
- BAROMETERS
- MAGNETOMETER
- IMUS
